# EasyEDA Pro project PRO_project.eprj, schematic Schematic1

## Sheets
1 mcu: Create Date: 2024-07-25; Page Name: mcu; Project Name: PRO_project; Schematic Name: Schematic1; Update Date: 2024-08-12; Company: 嘉立创EDA; Page Size: A4; Version: V1.0
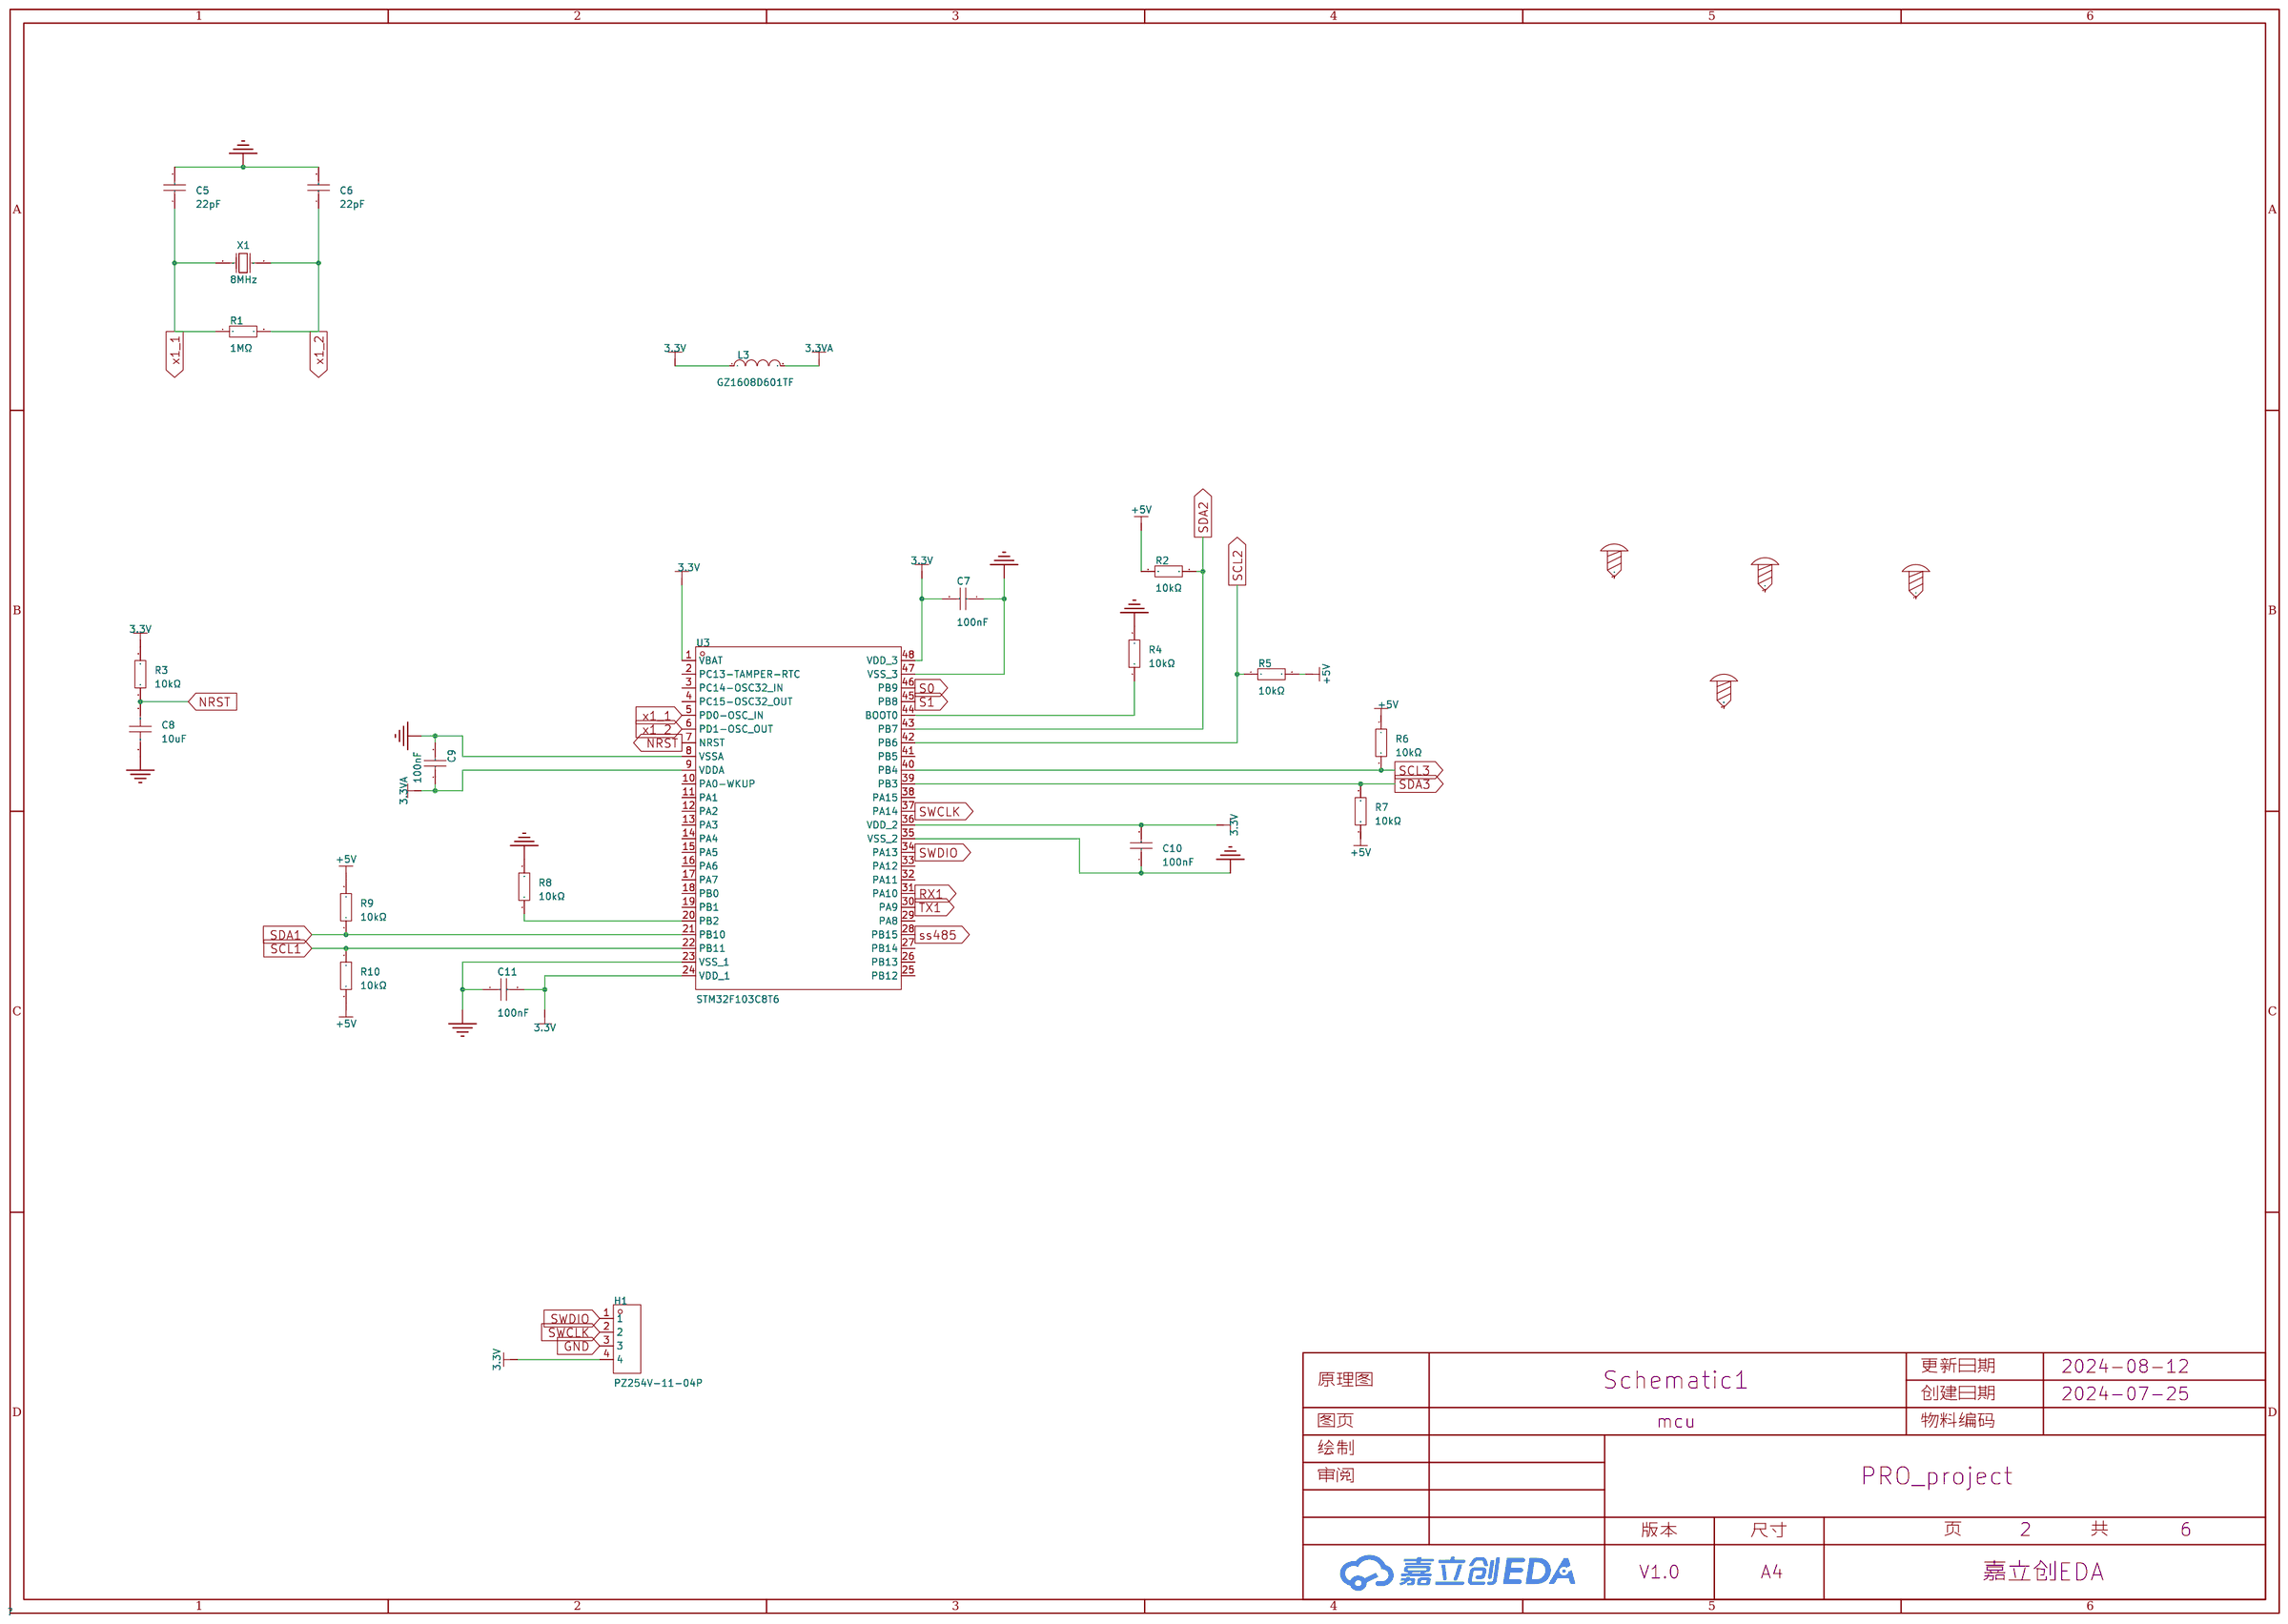
[diagram p0: mcu]
2 power: Page Name: power; Update Date: 2024-07-26
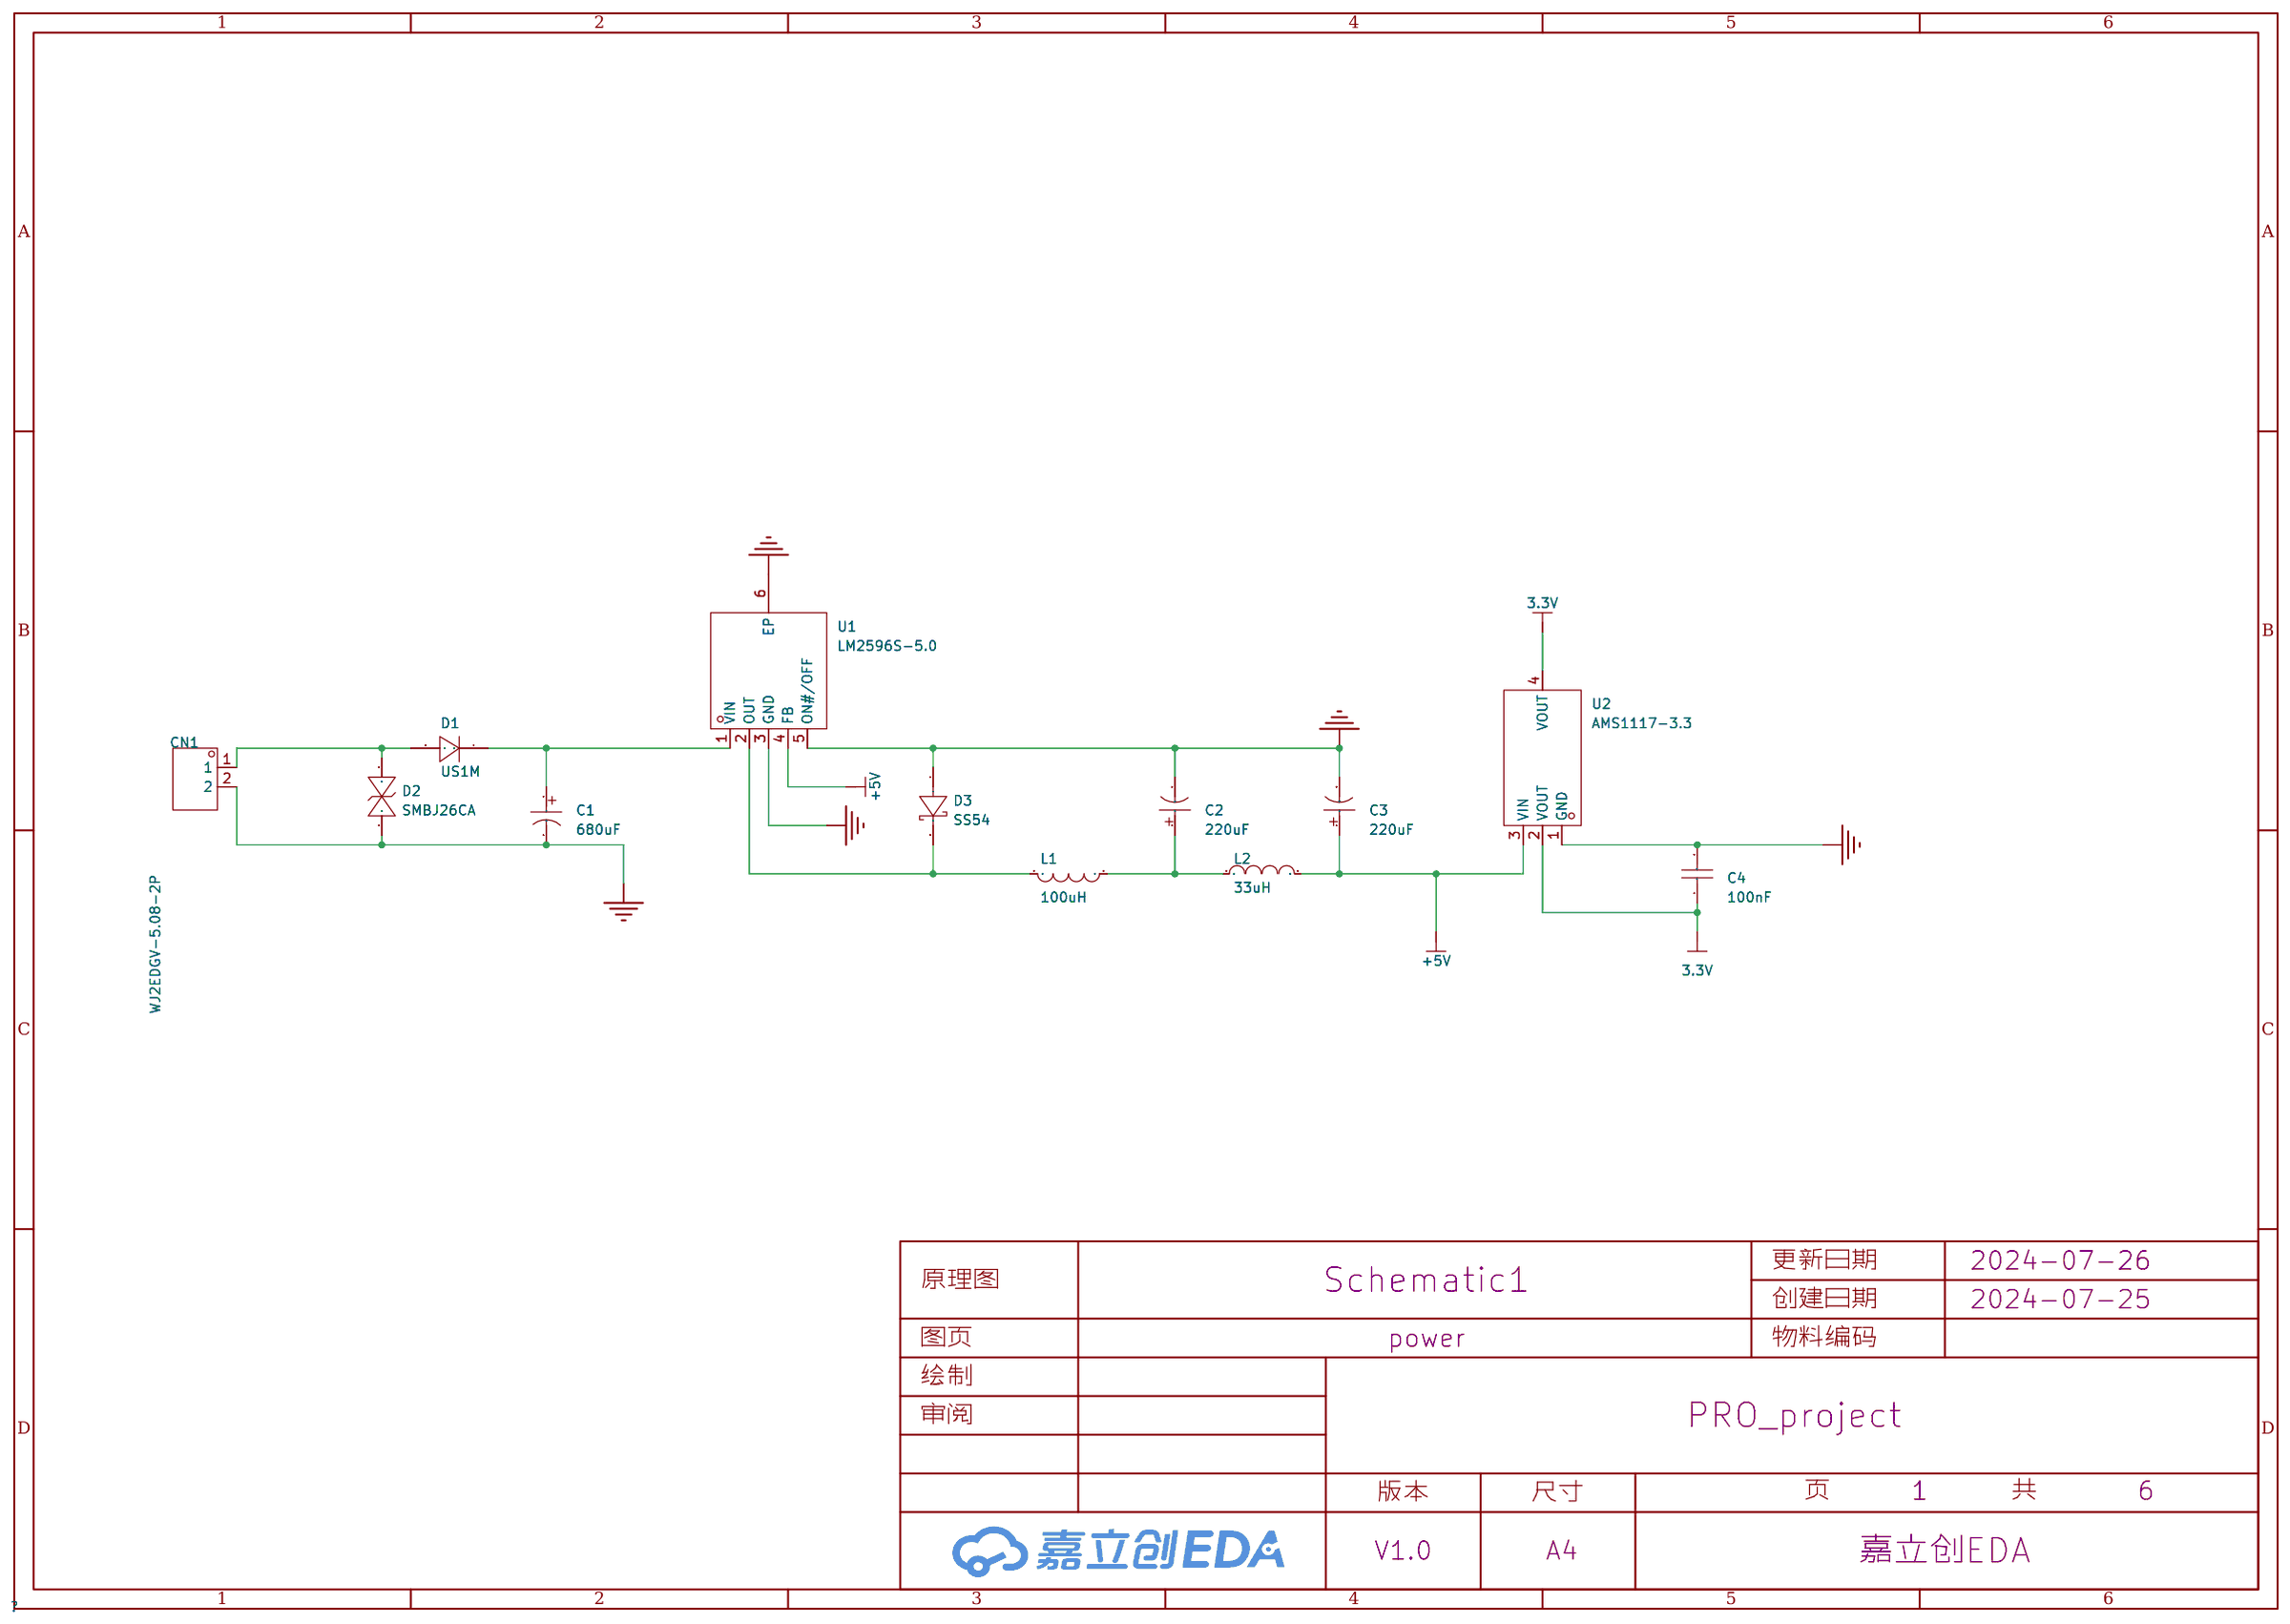
[diagram p1: power]
3 74H: Page Name: 74H; Update Date: 2024-08-04
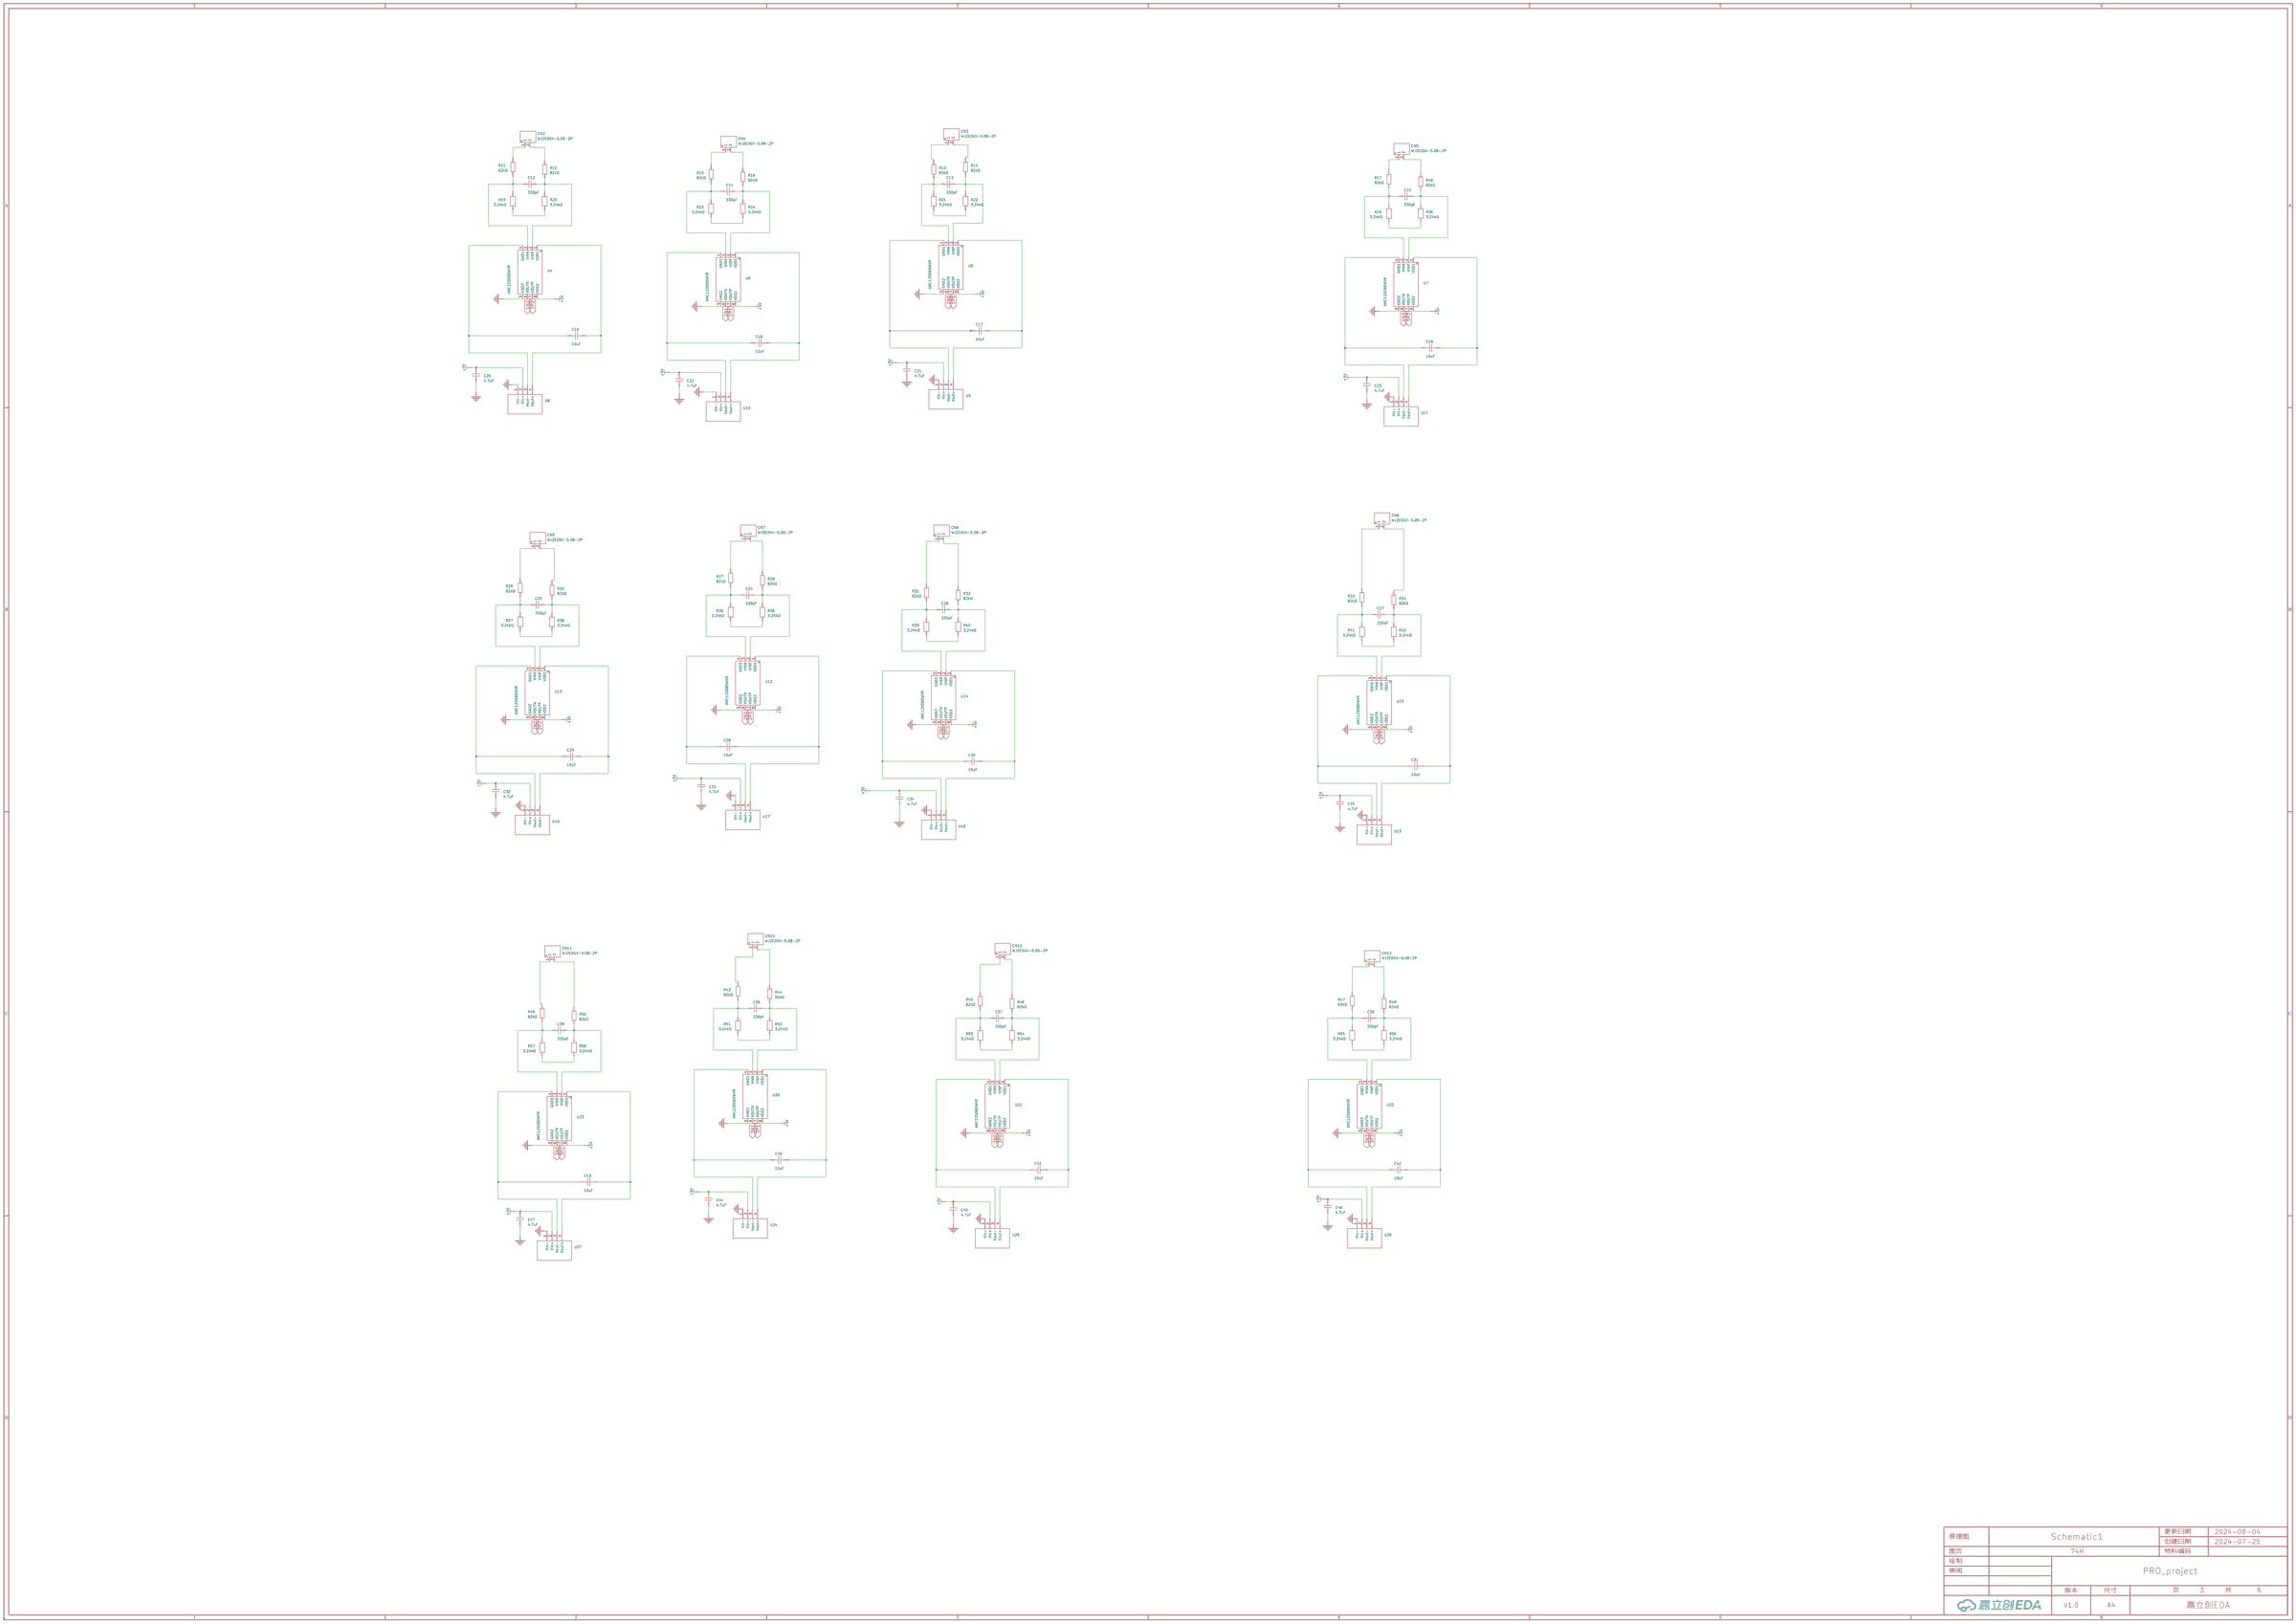
[diagram p2: 74H]
4 rs485: Page Name: rs485; Update Date: 2024-08-10